# EasyEDA Pro project 定时喝水PCB.eprj, schematic 参考1_P1.schdoc
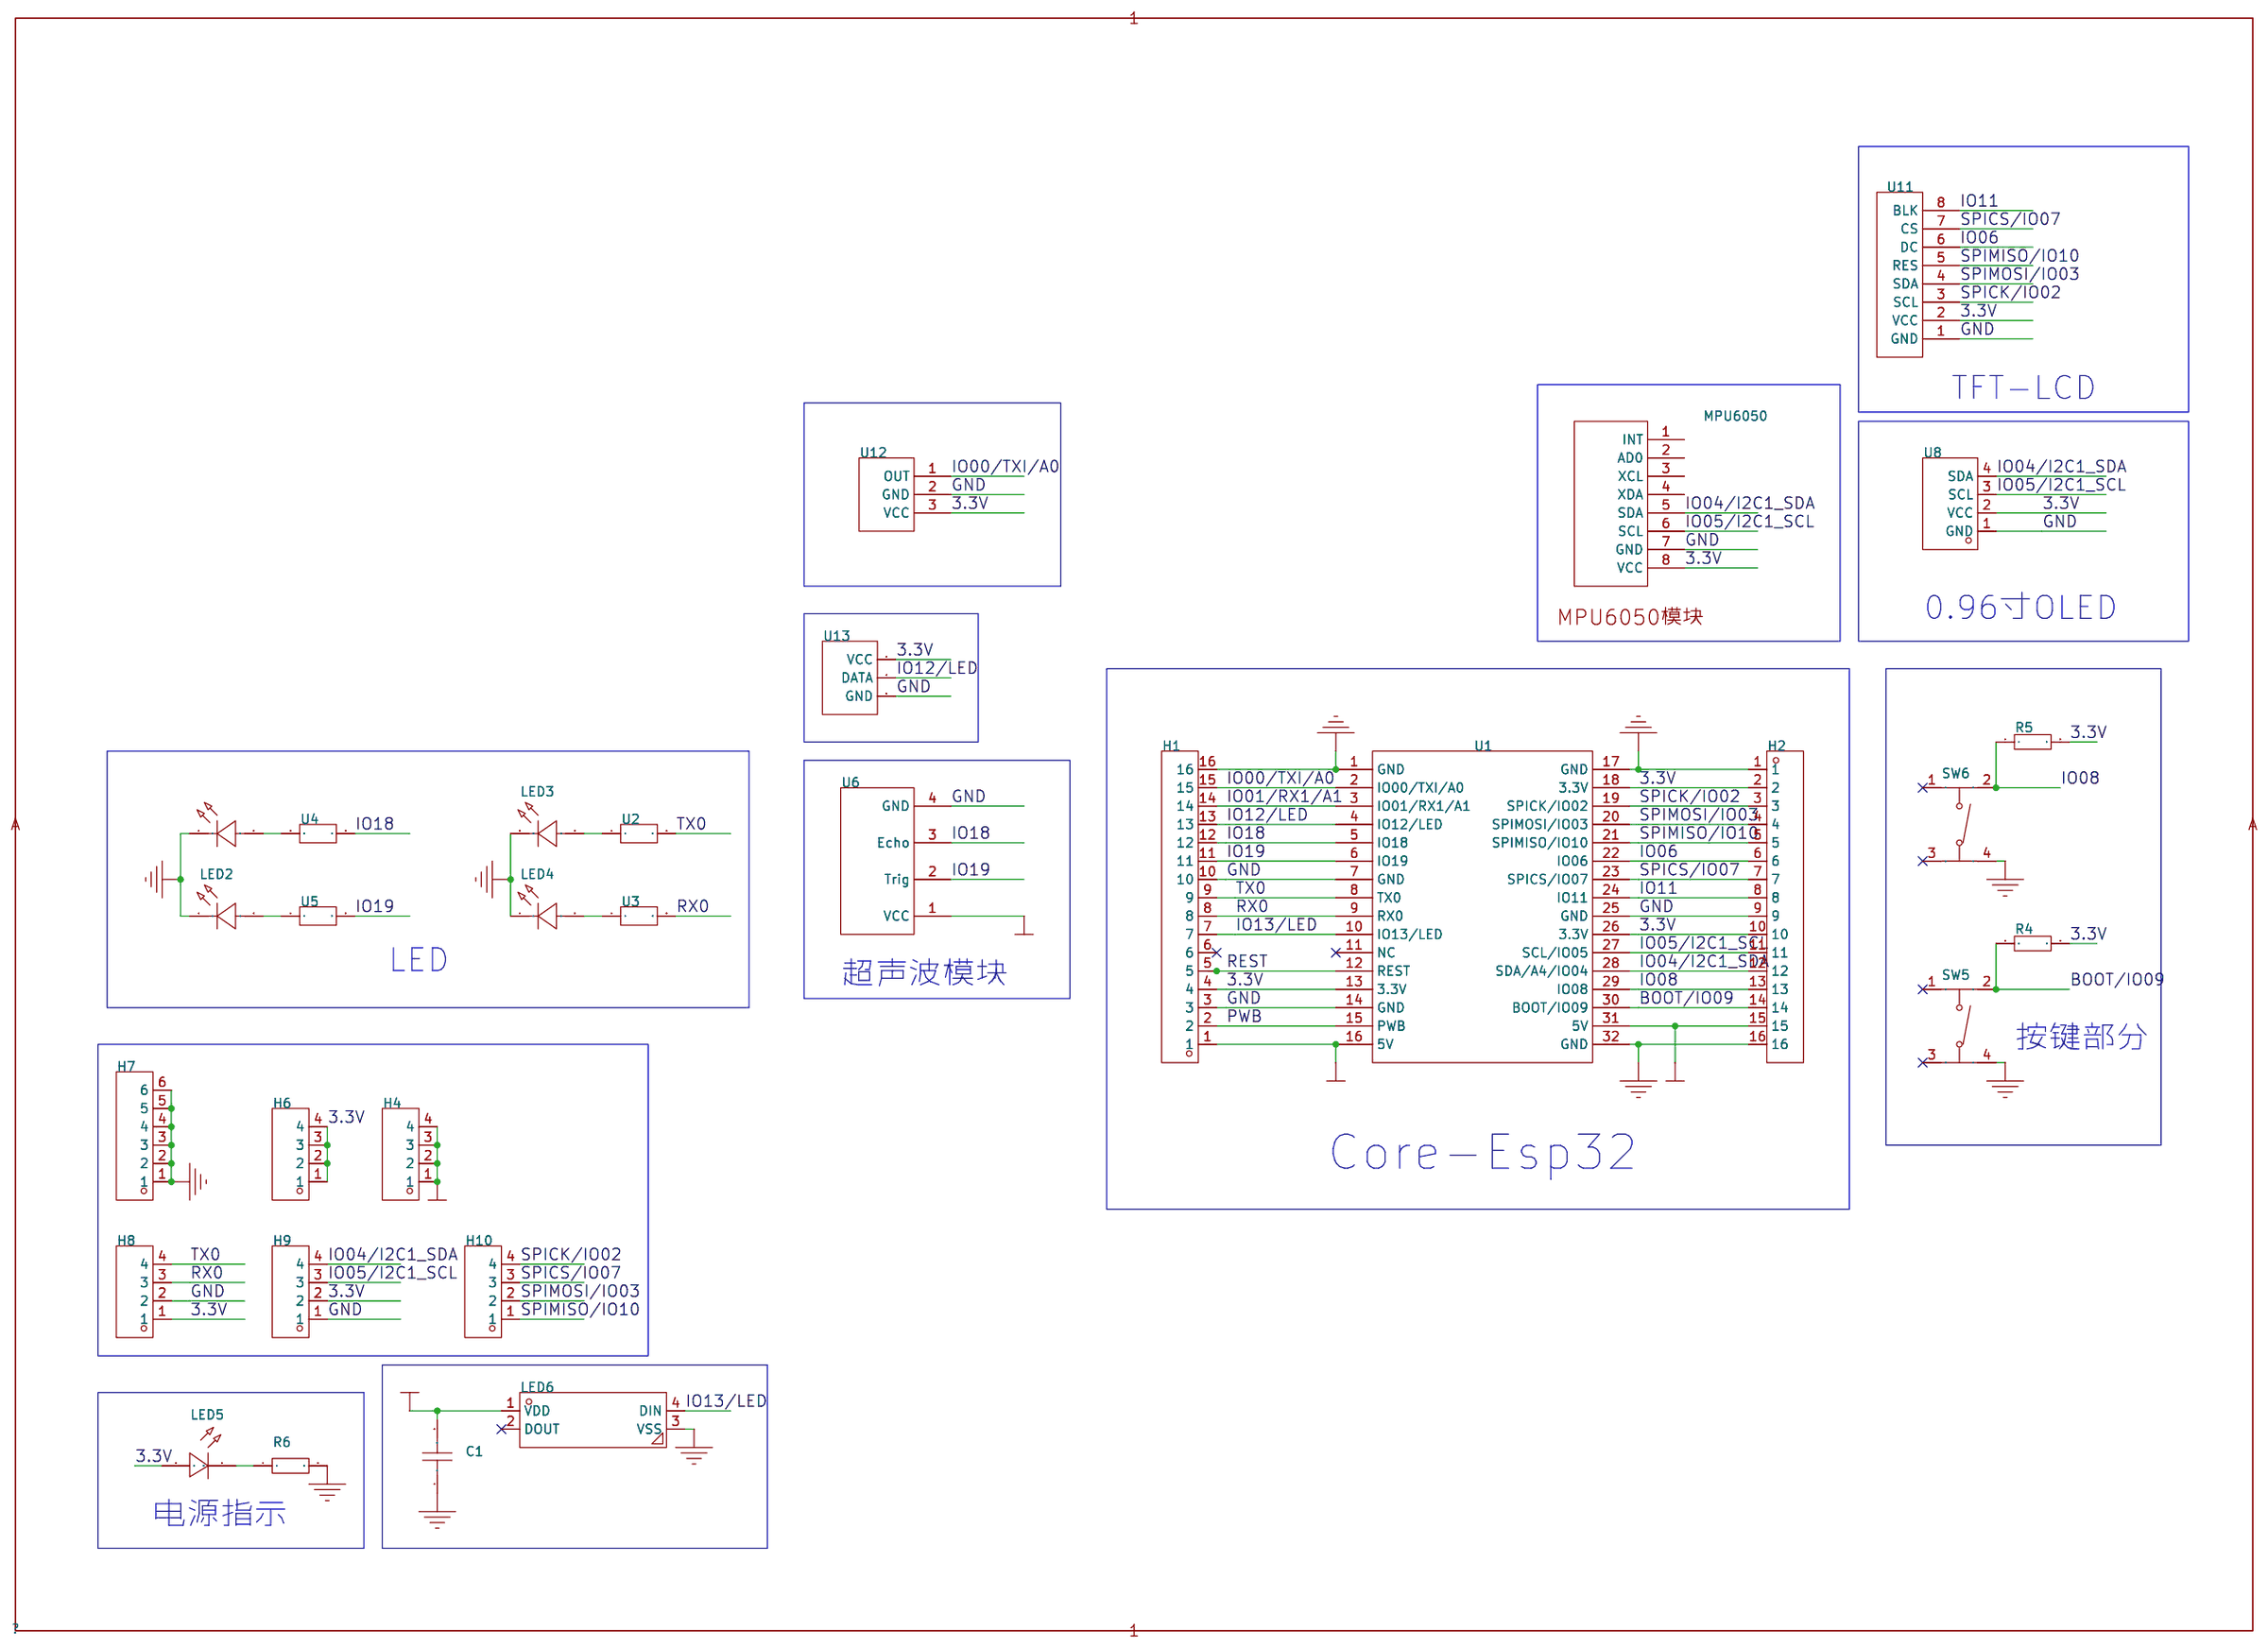
[diagram p1: schematic sheet]

## Parts
C1  100nF
H1  HDR-M_2.54_1x16P
H2  HDR-M_2.54_1x16P
H4  HDR-M_2.54_1x4P
H6  HDR-M_2.54_1x4P
H7  HDR-F_2.54_1x6P
H8  HDR-F_2.54_1x4P
H9  HDR-F_2.54_1x4P
H10  HDR-F_2.54_1x4P
LED1  XL-2012SURC
LED2  XL-2012SURC
LED3  XL-2012SURC
LED4  XL-2012SURC
LED5  LED_0805-R
LED6  WS2812E
MPU6050  MPU6050模块
R4  10kΩ
R5  10kΩ
R6  1K
SW5  SWS12X12
SW6  SWS12X12
U1  ESP32C3-合宙
U2  1kΩ
U3  1kΩ
U4  1kΩ
U5  1kΩ
U6  HC-SR04
U8  HS96L03W2C03
U11  TFT_LCD_1.8INCH_SPI
U12  MAX4466
U13  DHT11

## Library data of the parts
C1 = 100nF: Supplier Footprint: 0603; Origin Footprint 2: C0603; Origin Footprint 1: CAP_0603
H1 H2 = HDR-M_2.54_1x16P: 间距:2.54mm;总PIN位数:16;排数:1;插针结构:1x16P;行距:-;安装类型:直插;圆针/方针:方针;额定电流:3A;额定电压:-;配合针长度:6mm;塑高:2.5mm;端接针长度:3mm;触头材质:-;工作温度范围:-40℃~+105℃;颜色:黑色;; Supplier Part: C2894939; Supplier Footprint: 插件; Origin Footprint 2: HDR-TH_16P-P2.54-V-M
H4 H6 = HDR-M_2.54_1x4P: Supplier: LCSC; Supplier Part: C492403; Manufacturer: XFCN(兴飞); Manufacturer Part: PZ254V-11-04P; JLCPCB Part Class: Extended Part; Supplier Footprint: 插件; Origin Footprint 2: HDR-TH_4P-P2.54-V-M
H7 = HDR-F_2.54_1x6P: Supplier: LCSC; Manufacturer: BOOMELE(博穆精密); Manufacturer Part: 2.54-1*6P母; Supplier Part: C40877; JLCPCB Part Class: Extended Part; Supplier Footprint: 插件; Origin Footprint 2: HDR-TH_6P-P2.54-V-F
H8-H10 = HDR-F_2.54_1x4P: Supplier: LCSC; Supplier Part: C2718488; Manufacturer: BOOMELE(博穆精密); Manufacturer Part: 2.54-1*4P母; JLCPCB Part Class: Extended Part; Supplier Footprint: 插件; Origin Footprint 2: HDR-TH_4P-P2.54-V-F
LED1-LED4 = XL-2012SURC: 发光颜色:红灯;主波长:617nm~621nm;色温:-;功率:55mW;安装方式:正贴;; LCSC Part Name: 红灯 正贴; Supplier Part: C965812; Manufacturer: XINGLIGHT(成兴光); Supplier Footprint: 0805; Datasheet: https://atta.szlcsc.com/upload/public/pdf/source/20221102/49E1A0A365644091E6270AF1C5E0FE37.pdf; Supplier: LCSC; Emitted Color: 红灯; Lens Color: 无色透明; Dominant Wavelength: 617nm~621nm; Peak Wavelength: 623nm; Forward Current: 25mA; Power Dissipation: 55mW; Viewing Angle: 120°; Mounting Sytle: 正贴; Operating Temperature: -30℃~+85℃; Origin Footprint 2: LED0805-RD_RED
LED5 = LED_0805-R: Supplier Footprint: 0805; Origin Footprint 2: LED_0805
LED6 = WS2812E: 发光颜色:RGB三色;透镜颜色:无色透明透镜;; Supplier: LCSC; Supplier Part: C139127; Manufacturer: worldsemi; JLCPCB Part Class: 扩展库; LCSC Part Name: RGB三色 （注意防潮，请查阅规格书中对应具体内容）; Supplier Footprint: SMD5050; Datasheet: https://atta.szlcsc.com/upload/public/pdf/source/20191217/C473063_1AFA2F5FD6E31E5FA7E7F342219CDFCF.pdf; Emitted Color: RGB三色; Lens Color: 无色透明透镜; Origin Footprint 2: LED-SMD_4P-L5.0-W5.0-BL_TC5050RGB
MPU6050 = MPU6050模块: Pin Type: IN
R4 R5 = 10kΩ: 电阻类型:厚膜电阻;阻值:10kΩ;精度:±5%;功率:125mW;; LCSC Part Name: 10kΩ ±5% 125mW; Supplier Part: C100047; Manufacturer: YAGEO(国巨); Manufacturer Part: RC0805JR-0710KL; Supplier Footprint: 0805; Datasheet: https://atta.szlcsc.com/upload/public/pdf/source/20170708/1499509500945.pdf; Supplier: LCSC; Type: 厚膜电阻; Tolerance: ±5%; Power(Watts): 125mW; Temperature Coefficient: ±100ppm/℃; Overload Voltage (Max): 150V; Operating Temperature Range: -55℃~+155℃; Origin Footprint 2: R0805; Origin Footprint 1: RC0805JR-0710KL
R6 = 1K: Supplier Footprint: 0805; Origin Footprint 2: R0805; Origin Footprint 1: Res_0805
SW5 SW6 = SWS12X12: 12×12×9.5 160GF 贴片轻触开关; LCSC Part Name: TS-1003S-BR09516; Supplier Part: C720373; Manufacturer: XUNPU(讯普); Manufacturer Part: TS-1003S-BR09516; Supplier Footprint: SMD,12×12×9.5mm; JLCPCB Part Class: 扩展库; Datasheet: https://atta.szlcsc.com/upload/public/pdf/source/20200812/C720366_617DC482C54F865674F2AEFB954EDAE4.pdf; Supplier: LCSC; Origin Footprint 2: SW-SMD_4P-L12.0-W12.0-P5.00-LS15.4
U1 = ESP32C3-合宙: ESP32C3-核心板-经典; Origin Footprint 2: esp32c3-合宙
U2-U5 = 1kΩ: 阻值:1kΩ;精度:±1%;功率:125mW;温度系数:±100ppm/℃;; LCSC Part Name: 1kΩ ±1% 125mW; Supplier Part: C3152181; Manufacturer: Sunway(信维通信); Manufacturer Part: SC0805F1001F4ANRH; Supplier Footprint: 0805; Datasheet: https://atta.szlcsc.com/upload/public/pdf/source/20220728/FFCE43BB6DF8FA16AEE331F0F4B289DE.pdf; Supplier: LCSC; Tolerance: ±1%; Power(Watts): 125mW; Temperature Coefficient: ±100ppm/℃; Origin Footprint 2: R0805; Origin Footprint 1: SC0805F1001F4ANRH
U6 = HC-SR04
U8 = HS96L03W2C03: 尺寸(inch)：0.96寸 0.96apos; 像素分辨率：128x64 128*64主控芯片：SSD1315 接口类型：I2C 外形:27.3*27.8；IIC/3SPI/4SPI串口通讯,工作温度范围-40℃—+70℃。4PIN黑底白光。; Supplier: LCSC; Supplier Part: C5248080; Manufacturer: HS(汉昇); JLCPCB Part Class: Extended Part; LCSC Part Name: 0.96寸OLED显示屏窄白光IIC; Datasheet: https://atta.szlcsc.com/upload/public/pdf/source/20230627/763D01F79A90007632F098068C7C8AD9.pdf; Origin Footprint 2: OLED-TH_L27.8-W27.2-P2.54_C9900033791
U11 = TFT_LCD_1.8INCH_SPI: 合宙1.8寸TFTLCD 分辨率128*160 驱动IC ST7735S SPI串口; Origin Footprint 2: TFT_LCD_1.8INCH
U12 = MAX4466: 麦克风模块
U13 = DHT11: Supplier Part: C115245; Supplier: LCSC; JLCPCB Part Class: 扩展库

## Nets
3.3V: H1.4 H2.2 H2.10 H6.1 H6.2 H6.3 H6.4 H8.1 H9.2 LED5.2(A) MPU6050.8(VCC) R4.2 R5.2 U1.13(3.3V) U1.18(3.3V) U1.26(3.3V) U8.2(VCC) U11.2(VCC) U12.3(VCC) U13.1(VCC)
+5V: C1.2 H1.1 H2.15 H4.1 H4.2 H4.3 H4.4 LED6.1(VDD) U1.16(5V) U1.31(5V) U6.1(VCC)
GND: C1.1 H1.3 H1.10 H1.16 H2.1 H2.9 H2.16 H7.1 H7.2 H7.3 H7.4 H7.5 H7.6 H8.2 H9.1 LED1.1(K) LED2.1(K) LED3.1(K) LED4.1(K) LED6.3(VSS) MPU6050.7(GND) R6.2 SW5.4 SW6.4 U1.1(GND) U1.7(GND) U1.14(GND) U1.17(GND) U1.25(GND) U1.32(GND) U6.4(GND) U8.1(GND) U11.1(GND) U12.2(GND) U13.3(GND)
BOOT/IO09: H2.14 R4.1 SW5.2 U1.30(BOOT/IO09)
IO00/TXI/A0: H1.15 U1.2(IO00/TXI/A0) U12.1(OUT)
IO01/RX1/A1: H1.14 U1.3(IO01/RX1/A1)
IO04/I2C1_SDA: H2.12 H9.4 U1.28(SDA/A4/IO04) U8.4(SDA)
IO05/I2C1_SCL: H2.11 H9.3 U1.27(SCL/IO05) U8.3(SCL)
IO06: H2.6 U1.22(IO06) U11.6(DC)
IO08: H2.13 R5.1 SW6.2 U1.29(IO08)
IO11: H2.8 U1.24(IO11) U11.8(BLK)
IO12/LED: H1.13 U1.4(IO12/LED) U13.2(DATA)
IO13/LED: H1.7 LED6.4(DIN) U1.10(IO13/LED)
IO18: H1.12 U1.5(IO18) U4.2 U6.3(Echo)
IO19: H1.11 U1.6(IO19) U5.2 U6.2(Trig)
PWB: H1.2 U1.15(PWB)
REST: H1.5 U1.12(REST)
RX0: H1.8 H8.3 U1.9(RX0) U3.2
SPICK/IO02: H2.3 H10.4 U1.19(SPICK/IO02) U11.3(SCL)
SPICS/IO07: H2.7 H10.3 U1.23(SPICS/IO07) U11.7(CS)
SPIMISO/IO10: H2.5 H10.1 U1.21(SPIMISO/IO10) U11.5(RES)
SPIMOSI/IO03: H2.4 H10.2 U1.20(SPIMOSI/IO03) U11.4(SDA)
TX0: H1.9 H8.4 U1.8(TX0) U2.2
Net-(LED1-2): LED1.2(A) U4.1
Net-(LED2-2): LED2.2(A) U5.1
Net-(LED3-2): LED3.2(A) U2.1
Net-(LED4-2): LED4.2(A) U3.1
Net-(LED5-1): LED5.1(C) R6.1

Not connected (* = marked no-connect by the designer): H1 6*; LED6 2(DOUT)*; MPU6050 1(INT) 2(AD0) 3(XCL) 4(XDA) 5(SDA) 6(SCL); SW5 1* 3*; SW6 1* 3*; U1 11(NC)*

## Notes on the sheet
- TFT-LCD
- 0.96寸OLED
- LED
- 超声波模块
- 按键部分
- Core-Esp32
- 电源指示
